# EAGLE board Resistor_Resistor (EAGLE 8.3.0), part 2 of 32
## Placement (x,y rotation side) (continued)
R1310  10K  [0201]  32.66,67.72 0 top
R1311  10K  [0201]  32.66,68.33 0 top
R1312  10K  [0201]  32.66,68.94 0 top
R1313  10K  [0201]  32.66,69.55 0 top
R1314  10K  [0201]  32.66,70.15 0 top
R1315  10K  [0201]  32.66,70.76 0 top
R1316  10K  [0201]  32.66,71.37 0 top
R1317  10K  [0201]  32.66,71.98 0 top
R1318  10K  [0201]  32.66,72.59 0 top
R1319  10K  [0201]  32.66,73.2 0 top
R1320  10K  [0201]  32.66,73.81 0 top
R1321  10K  [0201]  32.66,74.42 0 top
R1322  10K  [0201]  32.66,75.03 0 top
R1323  10K  [0201]  32.66,75.64 0 top
R1324  10K  [0201]  32.66,76.25 0 top
R1325  10K  [0201]  32.66,76.86 0 top
R1326  10K  [0201]  32.66,77.47 0 top
R1327  10K  [0201]  32.66,78.08 0 top
R1328  10K  [0201]  32.66,78.69 0 top
R1329  10K  [0201]  32.66,79.3 0 top
R1330  10K  [0201]  32.66,79.91 0 top
R1331  10K  [0201]  32.66,80.52 0 top
R1332  10K  [0201]  32.66,81.13 0 top
R1333  10K  [0201]  32.66,81.74 0 top
R1334  10K  [0201]  32.66,82.35 0 top
R1335  10K  [0201]  32.66,82.96 0 top
R1336  10K  [0201]  32.66,83.57 0 top
R1337  10K  [0201]  32.66,84.18 0 top
R1338  10K  [0201]  32.66,84.79 0 top
R1339  10K  [0201]  32.66,85.39 0 top
R1340  10K  [0201]  32.66,86 0 top
R1341  10K  [0201]  32.66,86.61 0 top
R1342  10K  [0201]  32.66,87.22 0 top
R1343  10K  [0201]  32.66,87.83 0 top
R1344  10K  [0201]  32.66,88.44 0 top
R1345  10K  [0201]  32.66,89.05 0 top
R1346  10K  [0201]  32.66,89.66 0 top
R1347  10K  [0201]  32.66,90.27 0 top
R1348  10K  [0201]  32.66,90.88 0 top
R1349  10K  [0201]  32.66,91.49 0 top
R1350  10K  [0201]  32.66,92.1 0 top
R1351  10K  [0201]  32.66,92.71 0 top
R1352  10K  [0201]  32.66,93.32 0 top
R1353  10K  [0201]  32.66,93.93 0 top
R1354  10K  [0201]  32.66,94.54 0 top
R1355  10K  [0201]  32.66,95.15 0 top
R1356  10K  [0201]  32.66,95.76 0 top
R1357  10K  [0201]  32.66,96.37 0 top
R1358  10K  [0201]  32.66,96.98 0 top
R1359  10K  [0201]  32.66,97.59 0 top
R1360  10K  [0201]  32.66,98.2 0 top
R1361  10K  [0201]  32.66,98.81 0 top
R1362  10K  [0201]  32.66,99.42 0 top
R1363  10K  [0201]  32.66,100.03 0 top
R1364  10K  [0201]  32.66,100.63 0 top
R1365  10K  [0201]  32.66,101.24 0 top
R1366  10K  [0201]  32.66,101.85 0 top
R1367  10K  [0201]  32.66,102.46 0 top
R1368  10K  [0201]  32.66,103.07 0 top
R1369  10K  [0201]  32.66,103.68 0 top
R1370  10K  [0201]  32.66,104.29 0 top
R1371  10K  [0201]  32.66,104.9 0 top
R1372  10K  [0201]  32.66,105.51 0 top
R1373  10K  [0201]  32.66,106.12 0 top
R1374  10K  [0201]  32.66,106.73 0 top
R1375  10K  [0201]  32.66,107.34 0 top
R1376  10K  [0201]  32.66,107.95 0 top
R1377  10K  [0201]  32.66,108.56 0 top
R1378  10K  [0201]  32.66,109.17 0 top
R1379  10K  [0201]  32.66,109.78 0 top
R1380  10K  [0201]  32.66,110.39 0 top
R1381  10K  [0201]  32.66,111 0 top
R1382  10K  [0201]  32.66,111.61 0 top
R1383  10K  [0201]  32.66,112.22 0 top
R1384  10K  [0201]  32.66,112.83 0 top
R1385  10K  [0201]  32.66,113.44 0 top
R1386  10K  [0201]  32.66,114.05 0 top
R1387  10K  [0201]  32.66,114.66 0 top
R1388  10K  [0201]  32.66,115.27 0 top
R1389  10K  [0201]  32.66,115.87 0 top
R1390  10K  [0201]  32.66,116.48 0 top
R1391  10K  [0201]  32.66,117.09 0 top
R1392  10K  [0201]  32.66,117.7 0 top
R1393  10K  [0201]  32.66,118.31 0 top
R1394  10K  [0201]  32.66,118.92 0 top
R1395  10K  [0201]  32.66,119.53 0 top
R1396  10K  [0201]  32.66,120.14 0 top
R1397  10K  [0201]  32.66,120.75 0 top
R1398  10K  [0201]  32.66,121.36 0 top
R1399  10K  [0201]  32.66,121.97 0 top
R1400  10K  [0201]  32.66,122.58 0 top
R1401  10K  [0201]  33.88,1.27 0 top
R1402  10K  [0201]  33.88,1.88 0 top
R1403  10K  [0201]  33.88,2.49 0 top
R1404  10K  [0201]  33.88,3.1 0 top
R1405  10K  [0201]  33.88,3.71 0 top
R1406  10K  [0201]  33.88,4.32 0 top
R1407  10K  [0201]  33.88,4.93 0 top
R1408  10K  [0201]  33.88,5.54 0 top
R1409  10K  [0201]  33.88,6.15 0 top
R1410  10K  [0201]  33.88,6.76 0 top
R1411  10K  [0201]  33.88,7.37 0 top
R1412  10K  [0201]  33.88,7.98 0 top
R1413  10K  [0201]  33.88,8.59 0 top
R1414  10K  [0201]  33.88,9.19 0 top
R1415  10K  [0201]  33.88,9.8 0 top
R1416  10K  [0201]  33.88,10.41 0 top
R1417  10K  [0201]  33.88,11.02 0 top
R1418  10K  [0201]  33.88,11.63 0 top
R1419  10K  [0201]  33.88,12.24 0 top
R1420  10K  [0201]  33.88,12.85 0 top
R1421  10K  [0201]  33.88,13.46 0 top
R1422  10K  [0201]  33.88,14.07 0 top
R1423  10K  [0201]  33.88,14.68 0 top
R1424  10K  [0201]  33.88,15.29 0 top
R1425  10K  [0201]  33.88,15.9 0 top
R1426  10K  [0201]  33.88,16.51 0 top
R1427  10K  [0201]  33.88,17.12 0 top
R1428  10K  [0201]  33.88,17.73 0 top
R1429  10K  [0201]  33.88,18.34 0 top
R1430  10K  [0201]  33.88,18.95 0 top
R1431  10K  [0201]  33.88,19.56 0 top
R1432  10K  [0201]  33.88,20.17 0 top
R1433  10K  [0201]  33.88,20.78 0 top
R1434  10K  [0201]  33.88,21.39 0 top
R1435  10K  [0201]  33.88,22 0 top
R1436  10K  [0201]  33.88,22.61 0 top
R1437  10K  [0201]  33.88,23.22 0 top
R1438  10K  [0201]  33.88,23.83 0 top
R1439  10K  [0201]  33.88,24.43 0 top
R1440  10K  [0201]  33.88,25.04 0 top
R1441  10K  [0201]  33.88,25.65 0 top
R1442  10K  [0201]  33.88,26.26 0 top
R1443  10K  [0201]  33.88,26.87 0 top
R1444  10K  [0201]  33.88,27.48 0 top
R1445  10K  [0201]  33.88,28.09 0 top
R1446  10K  [0201]  33.88,28.7 0 top
R1447  10K  [0201]  33.88,29.31 0 top
R1448  10K  [0201]  33.88,29.92 0 top
R1449  10K  [0201]  33.88,30.53 0 top
R1450  10K  [0201]  33.88,31.14 0 top
R1451  10K  [0201]  33.88,31.75 0 top
R1452  10K  [0201]  33.88,32.36 0 top
R1453  10K  [0201]  33.88,32.97 0 top
R1454  10K  [0201]  33.88,33.58 0 top
R1455  10K  [0201]  33.88,34.19 0 top
R1456  10K  [0201]  33.88,34.8 0 top
R1457  10K  [0201]  33.88,35.41 0 top
R1458  10K  [0201]  33.88,36.02 0 top
R1459  10K  [0201]  33.88,36.63 0 top
R1460  10K  [0201]  33.88,37.24 0 top
R1461  10K  [0201]  33.88,37.85 0 top
R1462  10K  [0201]  33.88,38.46 0 top
R1463  10K  [0201]  33.88,39.07 0 top
R1464  10K  [0201]  33.88,39.67 0 top
R1465  10K  [0201]  33.88,40.28 0 top
R1466  10K  [0201]  33.88,40.89 0 top
R1467  10K  [0201]  33.88,41.5 0 top
R1468  10K  [0201]  33.88,42.11 0 top
R1469  10K  [0201]  33.88,42.72 0 top
R1470  10K  [0201]  33.88,43.33 0 top
R1471  10K  [0201]  33.88,43.94 0 top
R1472  10K  [0201]  33.88,44.55 0 top
R1473  10K  [0201]  33.88,45.16 0 top
R1474  10K  [0201]  33.88,45.77 0 top
R1475  10K  [0201]  33.88,46.38 0 top
R1476  10K  [0201]  33.88,46.99 0 top
R1477  10K  [0201]  33.88,47.6 0 top
R1478  10K  [0201]  33.88,48.21 0 top
R1479  10K  [0201]  33.88,48.82 0 top
R1480  10K  [0201]  33.88,49.43 0 top
R1481  10K  [0201]  33.88,50.04 0 top
R1482  10K  [0201]  33.88,50.65 0 top
R1483  10K  [0201]  33.88,51.26 0 top
R1484  10K  [0201]  33.88,51.87 0 top
R1485  10K  [0201]  33.88,52.48 0 top
R1486  10K  [0201]  33.88,53.09 0 top
R1487  10K  [0201]  33.88,53.7 0 top
R1488  10K  [0201]  33.88,54.31 0 top
R1489  10K  [0201]  33.88,54.91 0 top
R1490  10K  [0201]  33.88,55.52 0 top
R1491  10K  [0201]  33.88,56.13 0 top
R1492  10K  [0201]  33.88,56.74 0 top
R1493  10K  [0201]  33.88,57.35 0 top
R1494  10K  [0201]  33.88,57.96 0 top
R1495  10K  [0201]  33.88,58.57 0 top
R1496  10K  [0201]  33.88,59.18 0 top
R1497  10K  [0201]  33.88,59.79 0 top
R1498  10K  [0201]  33.88,60.4 0 top
R1499  10K  [0201]  33.88,61.01 0 top
R1500  10K  [0201]  33.88,61.62 0 top
R1501  10K  [0201]  33.88,62.23 0 top
R1502  10K  [0201]  33.88,62.84 0 top
R1503  10K  [0201]  33.88,63.45 0 top
R1504  10K  [0201]  33.88,64.06 0 top
R1505  10K  [0201]  33.88,64.67 0 top
R1506  10K  [0201]  33.88,65.28 0 top
R1507  10K  [0201]  33.88,65.89 0 top
R1508  10K  [0201]  33.88,66.5 0 top
R1509  10K  [0201]  33.88,67.11 0 top
R1510  10K  [0201]  33.88,67.72 0 top
R1511  10K  [0201]  33.88,68.33 0 top
R1512  10K  [0201]  33.88,68.94 0 top
R1513  10K  [0201]  33.88,69.55 0 top
R1514  10K  [0201]  33.88,70.15 0 top
R1515  10K  [0201]  33.88,70.76 0 top
R1516  10K  [0201]  33.88,71.37 0 top
R1517  10K  [0201]  33.88,71.98 0 top
R1518  10K  [0201]  33.88,72.59 0 top
R1519  10K  [0201]  33.88,73.2 0 top
R1520  10K  [0201]  33.88,73.81 0 top
R1521  10K  [0201]  33.88,74.42 0 top
R1522  10K  [0201]  33.88,75.03 0 top
R1523  10K  [0201]  33.88,75.64 0 top
R1524  10K  [0201]  33.88,76.25 0 top
R1525  10K  [0201]  33.88,76.86 0 top
R1526  10K  [0201]  33.88,77.47 0 top
R1527  10K  [0201]  33.88,78.08 0 top
R1528  10K  [0201]  33.88,78.69 0 top
R1529  10K  [0201]  33.88,79.3 0 top
R1530  10K  [0201]  33.88,79.91 0 top
R1531  10K  [0201]  33.88,80.52 0 top
R1532  10K  [0201]  33.88,81.13 0 top
R1533  10K  [0201]  33.88,81.74 0 top
R1534  10K  [0201]  33.88,82.35 0 top
R1535  10K  [0201]  33.88,82.96 0 top
R1536  10K  [0201]  33.88,83.57 0 top
R1537  10K  [0201]  33.88,84.18 0 top
R1538  10K  [0201]  33.88,84.79 0 top
R1539  10K  [0201]  33.88,85.39 0 top
R1540  10K  [0201]  33.88,86 0 top
R1541  10K  [0201]  33.88,86.61 0 top
R1542  10K  [0201]  33.88,87.22 0 top
R1543  10K  [0201]  33.88,87.83 0 top
R1544  10K  [0201]  33.88,88.44 0 top
R1545  10K  [0201]  33.88,89.05 0 top
R1546  10K  [0201]  33.88,89.66 0 top
R1547  10K  [0201]  33.88,90.27 0 top
R1548  10K  [0201]  33.88,90.88 0 top
R1549  10K  [0201]  33.88,91.49 0 top
R1550  10K  [0201]  33.88,92.1 0 top
R1551  10K  [0201]  33.88,92.71 0 top
R1552  10K  [0201]  33.88,93.32 0 top
R1553  10K  [0201]  33.88,93.93 0 top
R1554  10K  [0201]  33.88,94.54 0 top
R1555  10K  [0201]  33.88,95.15 0 top
R1556  10K  [0201]  33.88,95.76 0 top
R1557  10K  [0201]  33.88,96.37 0 top
R1558  10K  [0201]  33.88,96.98 0 top
R1559  10K  [0201]  33.88,97.59 0 top
R1560  10K  [0201]  33.88,98.2 0 top
R1561  10K  [0201]  33.88,98.81 0 top
R1562  10K  [0201]  33.88,99.42 0 top
R1563  10K  [0201]  33.88,100.03 0 top
R1564  10K  [0201]  33.88,100.63 0 top
R1565  10K  [0201]  33.88,101.24 0 top
R1566  10K  [0201]  33.88,101.85 0 top
R1567  10K  [0201]  33.88,102.46 0 top
R1568  10K  [0201]  33.88,103.07 0 top
R1569  10K  [0201]  33.88,103.68 0 top
R1570  10K  [0201]  33.88,104.29 0 top
R1571  10K  [0201]  33.88,104.9 0 top
R1572  10K  [0201]  33.88,105.51 0 top
R1573  10K  [0201]  33.88,106.12 0 top
R1574  10K  [0201]  33.88,106.73 0 top
R1575  10K  [0201]  33.88,107.34 0 top
R1576  10K  [0201]  33.88,107.95 0 top
R1577  10K  [0201]  33.88,108.56 0 top
R1578  10K  [0201]  33.88,109.17 0 top
R1579  10K  [0201]  33.88,109.78 0 top
R1580  10K  [0201]  33.88,110.39 0 top
R1581  10K  [0201]  33.88,111 0 top
R1582  10K  [0201]  33.88,111.61 0 top
R1583  10K  [0201]  33.88,112.22 0 top
R1584  10K  [0201]  33.88,112.83 0 top
R1585  10K  [0201]  33.88,113.44 0 top
R1586  10K  [0201]  33.88,114.05 0 top
R1587  10K  [0201]  33.88,114.66 0 top
R1588  10K  [0201]  33.88,115.27 0 top
R1589  10K  [0201]  33.88,115.87 0 top
R1590  10K  [0201]  33.88,116.48 0 top
R1591  10K  [0201]  33.88,117.09 0 top
R1592  10K  [0201]  33.88,117.7 0 top
R1593  10K  [0201]  33.88,118.31 0 top
R1594  10K  [0201]  33.88,118.92 0 top
R1595  10K  [0201]  33.88,119.53 0 top
R1596  10K  [0201]  33.88,120.14 0 top
R1597  10K  [0201]  33.88,120.75 0 top
R1598  10K  [0201]  33.88,121.36 0 top
R1599  10K  [0201]  33.88,121.97 0 top
R1600  10K  [0201]  33.88,122.58 0 top
R1601  10K  [0201]  35.1,1.27 0 top
R1602  10K  [0201]  35.1,1.88 0 top
R1603  10K  [0201]  35.1,2.49 0 top
R1604  10K  [0201]  35.1,3.1 0 top
R1605  10K  [0201]  35.1,3.71 0 top
R1606  10K  [0201]  35.1,4.32 0 top
R1607  10K  [0201]  35.1,4.93 0 top
R1608  10K  [0201]  35.1,5.54 0 top
R1609  10K  [0201]  35.1,6.15 0 top
R1610  10K  [0201]  35.1,6.76 0 top
R1611  10K  [0201]  35.1,7.37 0 top
R1612  10K  [0201]  35.1,7.98 0 top
R1613  10K  [0201]  35.1,8.59 0 top
R1614  10K  [0201]  35.1,9.19 0 top
R1615  10K  [0201]  35.1,9.8 0 top
R1616  10K  [0201]  35.1,10.41 0 top
R1617  10K  [0201]  35.1,11.02 0 top
R1618  10K  [0201]  35.1,11.63 0 top
R1619  10K  [0201]  35.1,12.24 0 top
R1620  10K  [0201]  35.1,12.85 0 top
R1621  10K  [0201]  35.1,13.46 0 top
R1622  10K  [0201]  35.1,14.07 0 top
R1623  10K  [0201]  35.1,14.68 0 top
R1624  10K  [0201]  35.1,15.29 0 top
R1625  10K  [0201]  35.1,15.9 0 top
R1626  10K  [0201]  35.1,16.51 0 top
R1627  10K  [0201]  35.1,17.12 0 top
R1628  10K  [0201]  35.1,17.73 0 top
R1629  10K  [0201]  35.1,18.34 0 top
R1630  10K  [0201]  35.1,18.95 0 top
R1631  10K  [0201]  35.1,19.56 0 top
R1632  10K  [0201]  35.1,20.17 0 top
R1633  10K  [0201]  35.1,20.78 0 top
R1634  10K  [0201]  35.1,21.39 0 top
R1635  10K  [0201]  35.1,22 0 top
R1636  10K  [0201]  35.1,22.61 0 top
R1637  10K  [0201]  35.1,23.22 0 top
R1638  10K  [0201]  35.1,23.83 0 top
R1639  10K  [0201]  35.1,24.43 0 top
R1640  10K  [0201]  35.1,25.04 0 top
R1641  10K  [0201]  35.1,25.65 0 top
R1642  10K  [0201]  35.1,26.26 0 top
R1643  10K  [0201]  35.1,26.87 0 top
R1644  10K  [0201]  35.1,27.48 0 top
R1645  10K  [0201]  35.1,28.09 0 top
R1646  10K  [0201]  35.1,28.7 0 top
R1647  10K  [0201]  35.1,29.31 0 top
R1648  10K  [0201]  35.1,29.92 0 top
R1649  10K  [0201]  35.1,30.53 0 top
R1650  10K  [0201]  35.1,31.14 0 top
R1651  10K  [0201]  35.1,31.75 0 top
R1652  10K  [0201]  35.1,32.36 0 top
R1653  10K  [0201]  35.1,32.97 0 top
R1654  10K  [0201]  35.1,33.58 0 top
R1655  10K  [0201]  35.1,34.19 0 top
R1656  10K  [0201]  35.1,34.8 0 top
R1657  10K  [0201]  35.1,35.41 0 top
R1658  10K  [0201]  35.1,36.02 0 top
R1659  10K  [0201]  35.1,36.63 0 top
R1660  10K  [0201]  35.1,37.24 0 top
R1661  10K  [0201]  35.1,37.85 0 top
R1662  10K  [0201]  35.1,38.46 0 top
R1663  10K  [0201]  35.1,39.07 0 top
R1664  10K  [0201]  35.1,39.67 0 top
R1665  10K  [0201]  35.1,40.28 0 top
R1666  10K  [0201]  35.1,40.89 0 top
R1667  10K  [0201]  35.1,41.5 0 top
R1668  10K  [0201]  35.1,42.11 0 top
R1669  10K  [0201]  35.1,42.72 0 top
R1670  10K  [0201]  35.1,43.33 0 top
R1671  10K  [0201]  35.1,43.94 0 top
R1672  10K  [0201]  35.1,44.55 0 top
R1673  10K  [0201]  35.1,45.16 0 top
R1674  10K  [0201]  35.1,45.77 0 top
R1675  10K  [0201]  35.1,46.38 0 top
R1676  10K  [0201]  35.1,46.99 0 top
R1677  10K  [0201]  35.1,47.6 0 top
R1678  10K  [0201]  35.1,48.21 0 top
R1679  10K  [0201]  35.1,48.82 0 top
R1680  10K  [0201]  35.1,49.43 0 top
R1681  10K  [0201]  35.1,50.04 0 top
R1682  10K  [0201]  35.1,50.65 0 top
R1683  10K  [0201]  35.1,51.26 0 top
R1684  10K  [0201]  35.1,51.87 0 top
R1685  10K  [0201]  35.1,52.48 0 top
R1686  10K  [0201]  35.1,53.09 0 top
R1687  10K  [0201]  35.1,53.7 0 top
R1688  10K  [0201]  35.1,54.31 0 top
R1689  10K  [0201]  35.1,54.91 0 top
R1690  10K  [0201]  35.1,55.52 0 top
R1691  10K  [0201]  35.1,56.13 0 top
R1692  10K  [0201]  35.1,56.74 0 top
R1693  10K  [0201]  35.1,57.35 0 top
R1694  10K  [0201]  35.1,57.96 0 top
R1695  10K  [0201]  35.1,58.57 0 top
R1696  10K  [0201]  35.1,59.18 0 top
R1697  10K  [0201]  35.1,59.79 0 top
R1698  10K  [0201]  35.1,60.4 0 top
R1699  10K  [0201]  35.1,61.01 0 top
R1700  10K  [0201]  35.1,61.62 0 top
R1701  10K  [0201]  35.1,62.23 0 top
R1702  10K  [0201]  35.1,62.84 0 top
R1703  10K  [0201]  35.1,63.45 0 top
R1704  10K  [0201]  35.1,64.06 0 top
R1705  10K  [0201]  35.1,64.67 0 top
R1706  10K  [0201]  35.1,65.28 0 top
R1707  10K  [0201]  35.1,65.89 0 top
R1708  10K  [0201]  35.1,66.5 0 top
R1709  10K  [0201]  35.1,67.11 0 top
R1710  10K  [0201]  35.1,67.72 0 top
R1711  10K  [0201]  35.1,68.33 0 top
R1712  10K  [0201]  35.1,68.94 0 top
R1713  10K  [0201]  35.1,69.55 0 top
R1714  10K  [0201]  35.1,70.15 0 top
R1715  10K  [0201]  35.1,70.76 0 top
R1716  10K  [0201]  35.1,71.37 0 top
R1717  10K  [0201]  35.1,71.98 0 top
R1718  10K  [0201]  35.1,72.59 0 top
R1719  10K  [0201]  35.1,73.2 0 top
R1720  10K  [0201]  35.1,73.81 0 top
R1721  10K  [0201]  35.1,74.42 0 top
R1722  10K  [0201]  35.1,75.03 0 top
R1723  10K  [0201]  35.1,75.64 0 top
R1724  10K  [0201]  35.1,76.25 0 top
R1725  10K  [0201]  35.1,76.86 0 top
R1726  10K  [0201]  35.1,77.47 0 top
R1727  10K  [0201]  35.1,78.08 0 top
R1728  10K  [0201]  35.1,78.69 0 top
R1729  10K  [0201]  35.1,79.3 0 top
R1730  10K  [0201]  35.1,79.91 0 top
R1731  10K  [0201]  35.1,80.52 0 top
R1732  10K  [0201]  35.1,81.13 0 top
R1733  10K  [0201]  35.1,81.74 0 top
R1734  10K  [0201]  35.1,82.35 0 top
R1735  10K  [0201]  35.1,82.96 0 top
R1736  10K  [0201]  35.1,83.57 0 top
R1737  10K  [0201]  35.1,84.18 0 top
R1738  10K  [0201]  35.1,84.79 0 top
R1739  10K  [0201]  35.1,85.39 0 top
R1740  10K  [0201]  35.1,86 0 top
R1741  10K  [0201]  35.1,86.61 0 top
R1742  10K  [0201]  35.1,87.22 0 top
R1743  10K  [0201]  35.1,87.83 0 top
R1744  10K  [0201]  35.1,88.44 0 top
R1745  10K  [0201]  35.1,89.05 0 top
R1746  10K  [0201]  35.1,89.66 0 top
R1747  10K  [0201]  35.1,90.27 0 top
R1748  10K  [0201]  35.1,90.88 0 top
R1749  10K  [0201]  35.1,91.49 0 top
R1750  10K  [0201]  35.1,92.1 0 top
R1751  10K  [0201]  35.1,92.71 0 top
R1752  10K  [0201]  35.1,93.32 0 top
R1753  10K  [0201]  35.1,93.93 0 top
R1754  10K  [0201]  35.1,94.54 0 top
R1755  10K  [0201]  35.1,95.15 0 top
R1756  10K  [0201]  35.1,95.76 0 top
R1757  10K  [0201]  35.1,96.37 0 top
R1758  10K  [0201]  35.1,96.98 0 top
R1759  10K  [0201]  35.1,97.59 0 top
R1760  10K  [0201]  35.1,98.2 0 top
R1761  10K  [0201]  35.1,98.81 0 top
R1762  10K  [0201]  35.1,99.42 0 top
R1763  10K  [0201]  35.1,100.03 0 top
R1764  10K  [0201]  35.1,100.63 0 top
R1765  10K  [0201]  35.1,101.24 0 top
R1766  10K  [0201]  35.1,101.85 0 top
R1767  10K  [0201]  35.1,102.46 0 top
R1768  10K  [0201]  35.1,103.07 0 top
R1769  10K  [0201]  35.1,103.68 0 top
R1770  10K  [0201]  35.1,104.29 0 top
R1771  10K  [0201]  35.1,104.9 0 top
R1772  10K  [0201]  35.1,105.51 0 top
R1773  10K  [0201]  35.1,106.12 0 top
R1774  10K  [0201]  35.1,106.73 0 top
R1775  10K  [0201]  35.1,107.34 0 top
R1776  10K  [0201]  35.1,107.95 0 top
R1777  10K  [0201]  35.1,108.56 0 top
R1778  10K  [0201]  35.1,109.17 0 top
R1779  10K  [0201]  35.1,109.78 0 top
R1780  10K  [0201]  35.1,110.39 0 top
R1781  10K  [0201]  35.1,111 0 top
R1782  10K  [0201]  35.1,111.61 0 top
R1783  10K  [0201]  35.1,112.22 0 top
R1784  10K  [0201]  35.1,112.83 0 top
R1785  10K  [0201]  35.1,113.44 0 top
R1786  10K  [0201]  35.1,114.05 0 top
R1787  10K  [0201]  35.1,114.66 0 top
R1788  10K  [0201]  35.1,115.27 0 top
R1789  10K  [0201]  35.1,115.87 0 top
R1790  10K  [0201]  35.1,116.48 0 top
R1791  10K  [0201]  35.1,117.09 0 top
R1792  10K  [0201]  35.1,117.7 0 top
R1793  10K  [0201]  35.1,118.31 0 top
R1794  10K  [0201]  35.1,118.92 0 top
R1795  10K  [0201]  35.1,119.53 0 top
R1796  10K  [0201]  35.1,120.14 0 top
R1797  10K  [0201]  35.1,120.75 0 top
R1798  10K  [0201]  35.1,121.36 0 top
R1799  10K  [0201]  35.1,121.97 0 top
R1800  10K  [0201]  35.1,122.58 0 top
R1801  10K  [0201]  36.32,1.27 0 top
R1802  10K  [0201]  36.32,1.88 0 top
R1803  10K  [0201]  36.32,2.49 0 top
R1804  10K  [0201]  36.32,3.1 0 top
R1805  10K  [0201]  36.32,3.71 0 top
R1806  10K  [0201]  36.32,4.32 0 top
R1807  10K  [0201]  36.32,4.93 0 top
R1808  10K  [0201]  36.32,5.54 0 top
R1809  10K  [0201]  36.32,6.15 0 top
R1810  10K  [0201]  36.32,6.76 0 top
R1811  10K  [0201]  36.32,7.37 0 top
R1812  10K  [0201]  36.32,7.98 0 top
R1813  10K  [0201]  36.32,8.59 0 top
R1814  10K  [0201]  36.32,9.19 0 top
R1815  10K  [0201]  36.32,9.8 0 top
R1816  10K  [0201]  36.32,10.41 0 top
R1817  10K  [0201]  36.32,11.02 0 top
R1818  10K  [0201]  36.32,11.63 0 top
R1819  10K  [0201]  36.32,12.24 0 top
R1820  10K  [0201]  36.32,12.85 0 top
R1821  10K  [0201]  36.32,13.46 0 top
R1822  10K  [0201]  36.32,14.07 0 top
R1823  10K  [0201]  36.32,14.68 0 top
R1824  10K  [0201]  36.32,15.29 0 top
R1825  10K  [0201]  36.32,15.9 0 top
R1826  10K  [0201]  36.32,16.51 0 top
R1827  10K  [0201]  36.32,17.12 0 top
R1828  10K  [0201]  36.32,17.73 0 top
R1829  10K  [0201]  36.32,18.34 0 top
R1830  10K  [0201]  36.32,18.95 0 top
R1831  10K  [0201]  36.32,19.56 0 top
R1832  10K  [0201]  36.32,20.17 0 top
R1833  10K  [0201]  36.32,20.78 0 top
R1834  10K  [0201]  36.32,21.39 0 top
R1835  10K  [0201]  36.32,22 0 top
R1836  10K  [0201]  36.32,22.61 0 top
R1837  10K  [0201]  36.32,23.22 0 top
R1838  10K  [0201]  36.32,23.83 0 top
R1839  10K  [0201]  36.32,24.43 0 top
R1840  10K  [0201]  36.32,25.04 0 top
R1841  10K  [0201]  36.32,25.65 0 top
R1842  10K  [0201]  36.32,26.26 0 top
R1843  10K  [0201]  36.32,26.87 0 top
R1844  10K  [0201]  36.32,27.48 0 top
R1845  10K  [0201]  36.32,28.09 0 top
R1846  10K  [0201]  36.32,28.7 0 top
R1847  10K  [0201]  36.32,29.31 0 top
R1848  10K  [0201]  36.32,29.92 0 top
R1849  10K  [0201]  36.32,30.53 0 top
R1850  10K  [0201]  36.32,31.14 0 top
R1851  10K  [0201]  36.32,31.75 0 top
R1852  10K  [0201]  36.32,32.36 0 top
R1853  10K  [0201]  36.32,32.97 0 top
R1854  10K  [0201]  36.32,33.58 0 top
R1855  10K  [0201]  36.32,34.19 0 top
R1856  10K  [0201]  36.32,34.8 0 top
R1857  10K  [0201]  36.32,35.41 0 top
R1858  10K  [0201]  36.32,36.02 0 top
R1859  10K  [0201]  36.32,36.63 0 top
R1860  10K  [0201]  36.32,37.24 0 top
R1861  10K  [0201]  36.32,37.85 0 top
R1862  10K  [0201]  36.32,38.46 0 top
R1863  10K  [0201]  36.32,39.07 0 top
R1864  10K  [0201]  36.32,39.67 0 top
R1865  10K  [0201]  36.32,40.28 0 top
R1866  10K  [0201]  36.32,40.89 0 top
R1867  10K  [0201]  36.32,41.5 0 top
R1868  10K  [0201]  36.32,42.11 0 top
R1869  10K  [0201]  36.32,42.72 0 top
R1870  10K  [0201]  36.32,43.33 0 top
R1871  10K  [0201]  36.32,43.94 0 top
R1872  10K  [0201]  36.32,44.55 0 top
R1873  10K  [0201]  36.32,45.16 0 top
R1874  10K  [0201]  36.32,45.77 0 top
R1875  10K  [0201]  36.32,46.38 0 top
R1876  10K  [0201]  36.32,46.99 0 top
R1877  10K  [0201]  36.32,47.6 0 top
R1878  10K  [0201]  36.32,48.21 0 top
R1879  10K  [0201]  36.32,48.82 0 top
R1880  10K  [0201]  36.32,49.43 0 top
R1881  10K  [0201]  36.32,50.04 0 top
R1882  10K  [0201]  36.32,50.65 0 top
R1883  10K  [0201]  36.32,51.26 0 top
R1884  10K  [0201]  36.32,51.87 0 top
R1885  10K  [0201]  36.32,52.48 0 top
R1886  10K  [0201]  36.32,53.09 0 top
R1887  10K  [0201]  36.32,53.7 0 top
R1888  10K  [0201]  36.32,54.31 0 top
R1889  10K  [0201]  36.32,54.91 0 top
R1890  10K  [0201]  36.32,55.52 0 top
R1891  10K  [0201]  36.32,56.13 0 top
R1892  10K  [0201]  36.32,56.74 0 top
R1893  10K  [0201]  36.32,57.35 0 top
R1894  10K  [0201]  36.32,57.96 0 top
R1895  10K  [0201]  36.32,58.57 0 top
R1896  10K  [0201]  36.32,59.18 0 top
R1897  10K  [0201]  36.32,59.79 0 top
R1898  10K  [0201]  36.32,60.4 0 top
R1899  10K  [0201]  36.32,61.01 0 top
R1900  10K  [0201]  36.32,61.62 0 top
R1901  10K  [0201]  36.32,62.23 0 top
R1902  10K  [0201]  36.32,62.84 0 top
R1903  10K  [0201]  36.32,63.45 0 top
R1904  10K  [0201]  36.32,64.06 0 top
R1905  10K  [0201]  36.32,64.67 0 top
R1906  10K  [0201]  36.32,65.28 0 top
R1907  10K  [0201]  36.32,65.89 0 top
R1908  10K  [0201]  36.32,66.5 0 top
R1909  10K  [0201]  36.32,67.11 0 top
R1910  10K  [0201]  36.32,67.72 0 top
R1911  10K  [0201]  36.32,68.33 0 top
R1912  10K  [0201]  36.32,68.94 0 top
R1913  10K  [0201]  36.32,69.55 0 top
R1914  10K  [0201]  36.32,70.15 0 top
R1915  10K  [0201]  36.32,70.76 0 top
R1916  10K  [0201]  36.32,71.37 0 top
R1917  10K  [0201]  36.32,71.98 0 top
R1918  10K  [0201]  36.32,72.59 0 top
R1919  10K  [0201]  36.32,73.2 0 top
R1920  10K  [0201]  36.32,73.81 0 top
R1921  10K  [0201]  36.32,74.42 0 top
R1922  10K  [0201]  36.32,75.03 0 top
R1923  10K  [0201]  36.32,75.64 0 top
R1924  10K  [0201]  36.32,76.25 0 top
R1925  10K  [0201]  36.32,76.86 0 top
R1926  10K  [0201]  36.32,77.47 0 top
R1927  10K  [0201]  36.32,78.08 0 top
R1928  10K  [0201]  36.32,78.69 0 top
R1929  10K  [0201]  36.32,79.3 0 top
R1930  10K  [0201]  36.32,79.91 0 top
R1931  10K  [0201]  36.32,80.52 0 top
R1932  10K  [0201]  36.32,81.13 0 top
R1933  10K  [0201]  36.32,81.74 0 top
R1934  10K  [0201]  36.32,82.35 0 top
R1935  10K  [0201]  36.32,82.96 0 top
R1936  10K  [0201]  36.32,83.57 0 top
R1937  10K  [0201]  36.32,84.18 0 top
R1938  10K  [0201]  36.32,84.79 0 top
R1939  10K  [0201]  36.32,85.39 0 top
R1940  10K  [0201]  36.32,86 0 top
R1941  10K  [0201]  36.32,86.61 0 top
R1942  10K  [0201]  36.32,87.22 0 top
R1943  10K  [0201]  36.32,87.83 0 top
R1944  10K  [0201]  36.32,88.44 0 top
R1945  10K  [0201]  36.32,89.05 0 top
R1946  10K  [0201]  36.32,89.66 0 top
R1947  10K  [0201]  36.32,90.27 0 top
R1948  10K  [0201]  36.32,90.88 0 top
R1949  10K  [0201]  36.32,91.49 0 top
R1950  10K  [0201]  36.32,92.1 0 top
R1951  10K  [0201]  36.32,92.71 0 top
R1952  10K  [0201]  36.32,93.32 0 top
R1953  10K  [0201]  36.32,93.93 0 top
R1954  10K  [0201]  36.32,94.54 0 top
R1955  10K  [0201]  36.32,95.15 0 top
R1956  10K  [0201]  36.32,95.76 0 top
R1957  10K  [0201]  36.32,96.37 0 top
R1958  10K  [0201]  36.32,96.98 0 top
R1959  10K  [0201]  36.32,97.59 0 top
R1960  10K  [0201]  36.32,98.2 0 top
R1961  10K  [0201]  36.32,98.81 0 top
R1962  10K  [0201]  36.32,99.42 0 top
R1963  10K  [0201]  36.32,100.03 0 top
R1964  10K  [0201]  36.32,100.63 0 top
R1965  10K  [0201]  36.32,101.24 0 top
R1966  10K  [0201]  36.32,101.85 0 top
R1967  10K  [0201]  36.32,102.46 0 top